# Altium schematic sheet Amps.SchDoc (part 2 of 2)
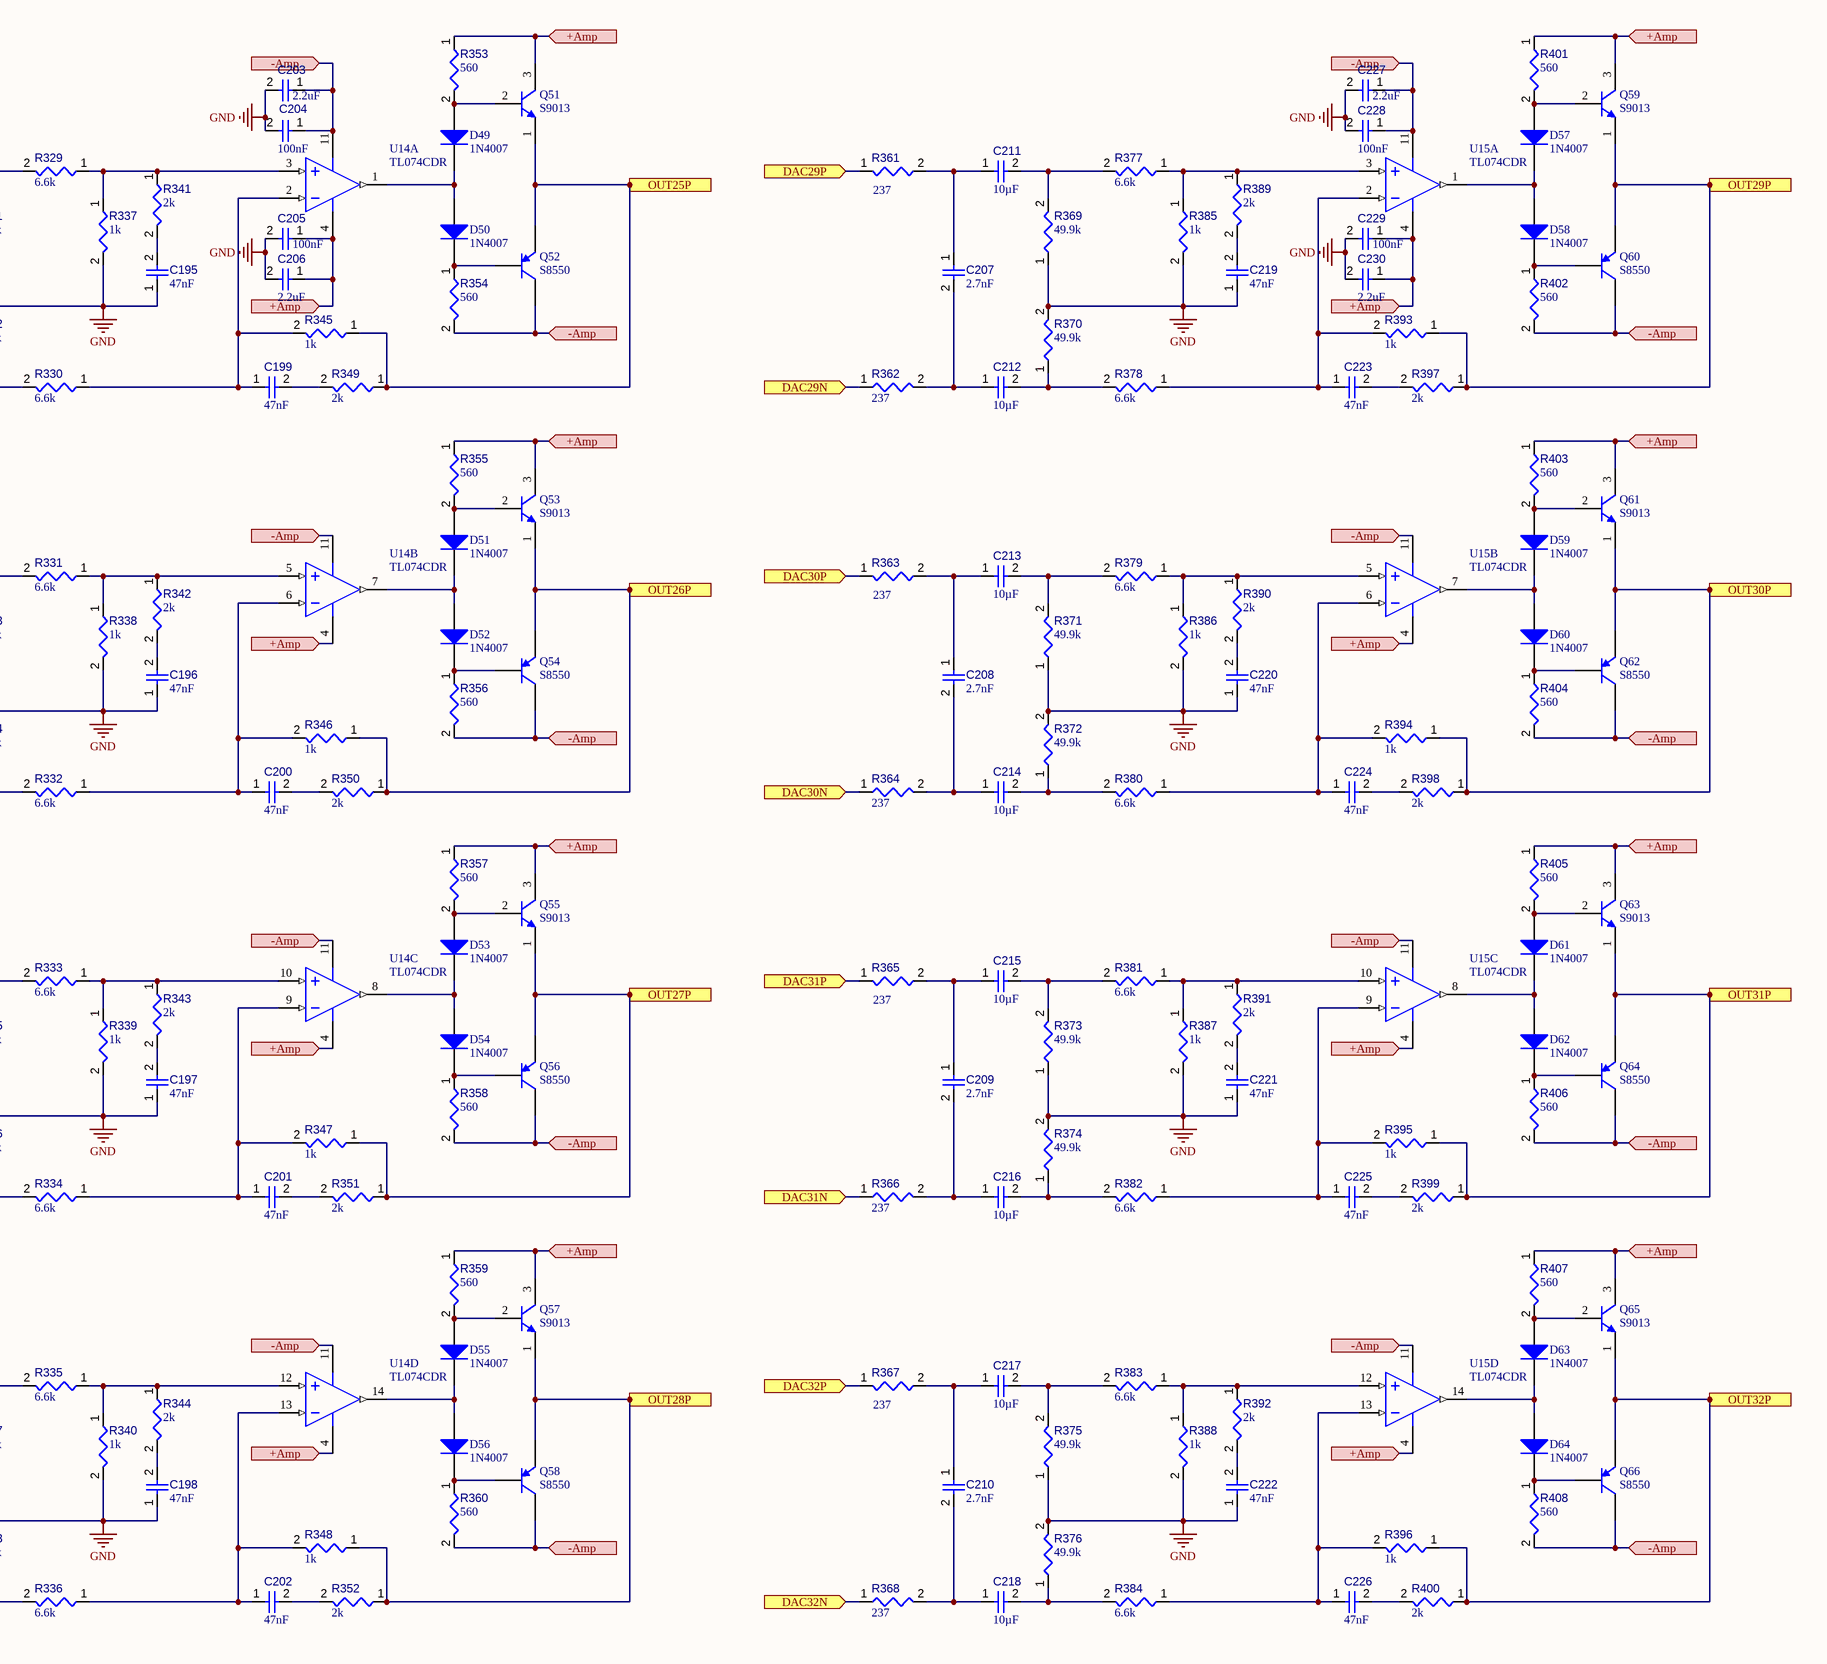
[diagram p5: Amps.SchDoc, column 5 of 5]

## Nets
GND: C51.1 C52.1 C53.1 C54.1 C59.2 C60.2 C61.2 C62.2 C75.1 C76.1 C77.1 C78.1 C83.2 C84.2 C85.2 C86.2 C99.1 C100.1 C101.1 C102.1 C107.2 C108.2 C109.2 C110.2 C123.1 C124.1 C125.1 C126.1 C131.2 C132.2 C133.2 C134.2 C147.1 C148.1 C149.1 C150.1 C155.2 C156.2 C157.2 C158.2 C171.1 C172.1 C173.1 C174.1 C179.2 C180.2 C181.2 C182.2 C195.1 C196.1 C197.1 C198.1 C203.2 C204.2 C205.2 C206.2 C219.1 C220.1 C221.1 C222.1 C227.2 C228.2 C229.2 C230.2 R33.1 R34.2 R35.1 R36.2 R37.1 R38.2 R39.1 R40.2 R49.2 R50.2 R51.2 R52.2 R81.1 R82.2 R83.1 R84.2 R85.1 R86.2 R87.1 R88.2 R97.2 R98.2 R99.2 R100.2 R129.1 R130.2 R131.1 R132.2 R133.1 R134.2 R135.1 R136.2 R145.2 R146.2 R147.2 R148.2 R177.1 R178.2 R179.1 R180.2 R181.1 R182.2 R183.1 R184.2 R193.2 R194.2 R195.2 R196.2 R225.1 R226.2 R227.1 R228.2 R229.1 R230.2 R231.1 R232.2 R241.2 R242.2 R243.2 R244.2 R273.1 R274.2 R275.1 R276.2 R277.1 R278.2 R279.1 R280.2 R289.2 R290.2 R291.2 R292.2 R321.1 R322.2 R323.1 R324.2 R325.1 R326.2 R327.1 R328.2 R337.2 R338.2 R339.2 R340.2 R369.1 R370.2 R371.1 R372.2 R373.1 R374.2 R375.1 R376.2 R385.2 R386.2 R387.2 R388.2
+Amp: C61.1 C62.1 C85.1 C86.1 C109.1 C110.1 C133.1 C134.1 C157.1 C158.1 C181.1 C182.1 C205.1 C206.1 C229.1 C230.1 Q3.3(C) Q5.3(C) Q7.3(C) Q9.3(C) Q11.3(C) Q13.3(C) Q15.3(C) Q17.3(C) Q19.3(C) Q21.3(C) Q23.3(C) Q25.3(C) Q27.3(C) Q29.3(C) Q31.3(C) Q33.3(C) Q35.3(C) Q37.3(C) Q39.3(C) Q41.3(C) Q43.3(C) Q45.3(C) Q47.3(C) Q49.3(C) Q51.3(C) Q53.3(C) Q55.3(C) Q57.3(C) Q59.3(C) Q61.3(C) Q63.3(C) Q65.3(C) R65.1 R67.1 R69.1 R71.1 R113.1 R115.1 R117.1 R119.1 R161.1 R163.1 R165.1 R167.1 R209.1 R211.1 R213.1 R215.1 R257.1 R259.1 R261.1 R263.1 R305.1 R307.1 R309.1 R311.1 R353.1 R355.1 R357.1 R359.1 R401.1 R403.1 R405.1 R407.1 U8.4(VCC+) U9.4(VCC+) U10.4(VCC+) U11.4(VCC+) U12.4(VCC+) U13.4(VCC+) U14.4(VCC+) U15.4(VCC+) ; port +Amp
-Amp: C59.1 C60.1 C83.1 C84.1 C107.1 C108.1 C131.1 C132.1 C155.1 C156.1 C179.1 C180.1 C203.1 C204.1 C227.1 C228.1 Q4.3(C) Q6.3(C) Q8.3(C) Q10.3(C) Q12.3(C) Q14.3(C) Q16.3(C) Q18.3(C) Q20.3(C) Q22.3(C) Q24.3(C) Q26.3(C) Q28.3(C) Q30.3(C) Q32.3(C) Q34.3(C) Q36.3(C) Q38.3(C) Q40.3(C) Q42.3(C) Q44.3(C) Q46.3(C) Q48.3(C) Q50.3(C) Q52.3(C) Q54.3(C) Q56.3(C) Q58.3(C) Q60.3(C) Q62.3(C) Q64.3(C) Q66.3(C) R66.2 R68.2 R70.2 R72.2 R114.2 R116.2 R118.2 R120.2 R162.2 R164.2 R166.2 R168.2 R210.2 R212.2 R214.2 R216.2 R258.2 R260.2 R262.2 R264.2 R306.2 R308.2 R310.2 R312.2 R354.2 R356.2 R358.2 R360.2 R402.2 R404.2 R406.2 R408.2 U8.11(VCC-) U9.11(VCC-) U10.11(VCC-) U11.11(VCC-) U12.11(VCC-) U13.11(VCC-) U14.11(VCC-) U15.11(VCC-) ; port -Amp
DAC1N: R26.1 ; port DAC1N
DAC1P: R25.1 ; port DAC1P
DAC2N: R28.1 ; port DAC2N
DAC2P: R27.1 ; port DAC2P
DAC3N: R30.1 ; port DAC3N
DAC3P: R29.1 ; port DAC3P
DAC4N: R32.1 ; port DAC4N
DAC4P: R31.1 ; port DAC4P
DAC5N: R74.1 ; port DAC5N
DAC5P: R73.1 ; port DAC5P
DAC6N: R76.1 ; port DAC6N
DAC6P: R75.1 ; port DAC6P
DAC7N: R78.1 ; port DAC7N
DAC7P: R77.1 ; port DAC7P
DAC8N: R80.1 ; port DAC8N
DAC8P: R79.1 ; port DAC8P
DAC9N: R122.1 ; port DAC9N
DAC9P: R121.1 ; port DAC9P
DAC10N: R124.1 ; port DAC10N
DAC10P: R123.1 ; port DAC10P
DAC11N: R126.1 ; port DAC11N
DAC11P: R125.1 ; port DAC11P
DAC12N: R128.1 ; port DAC12N
DAC12P: R127.1 ; port DAC12P
DAC13N: R170.1 ; port DAC13N
DAC13P: R169.1 ; port DAC13P
DAC14N: R172.1 ; port DAC14N
DAC14P: R171.1 ; port DAC14P
DAC15N: R174.1 ; port DAC15N
DAC15P: R173.1 ; port DAC15P
DAC16N: R176.1 ; port DAC16N
DAC16P: R175.1 ; port DAC16P
DAC17N: R218.1 ; port DAC17N
DAC17P: R217.1 ; port DAC17P
DAC18N: R220.1 ; port DAC18N
DAC18P: R219.1 ; port DAC18P
DAC19N: R222.1 ; port DAC19N
DAC19P: R221.1 ; port DAC19P
DAC20N: R224.1 ; port DAC20N
DAC20P: R223.1 ; port DAC20P
DAC21N: R266.1 ; port DAC21N
DAC21P: R265.1 ; port DAC21P
DAC22N: R268.1 ; port DAC22N
DAC22P: R267.1 ; port DAC22P
DAC23N: R270.1 ; port DAC23N
DAC23P: R269.1 ; port DAC23P
DAC24N: R272.1 ; port DAC24N
DAC24P: R271.1 ; port DAC24P
DAC25N: R314.1 ; port DAC25N
DAC25P: R313.1 ; port DAC25P
DAC26N: R316.1 ; port DAC26N
DAC26P: R315.1 ; port DAC26P
DAC27N: R318.1 ; port DAC27N
DAC27P: R317.1 ; port DAC27P
DAC28N: R320.1 ; port DAC28N
DAC28P: R319.1 ; port DAC28P
DAC29N: R362.1 ; port DAC29N
DAC29P: R361.1 ; port DAC29P
DAC30N: R364.1 ; port DAC30N
DAC30P: R363.1 ; port DAC30P
DAC31N: R366.1 ; port DAC31N
DAC31P: R365.1 ; port DAC31P
DAC32N: R368.1 ; port DAC32N
DAC32P: R367.1 ; port DAC32P
OUT1P: Q3.1(E) Q4.1(E) R57.1 R61.1 ; port OUT1P
OUT2P: Q5.1(E) Q6.1(E) R58.1 R62.1 ; port OUT2P
OUT3P: Q7.1(E) Q8.1(E) R59.1 R63.1 ; port OUT3P
OUT4P: Q9.1(E) Q10.1(E) R60.1 R64.1 ; port OUT4P
OUT5P: Q11.1(E) Q12.1(E) R105.1 R109.1 ; port OUT5P
OUT6P: Q13.1(E) Q14.1(E) R106.1 R110.1 ; port OUT6P
OUT7P: Q15.1(E) Q16.1(E) R107.1 R111.1 ; port OUT7P
OUT8P: Q17.1(E) Q18.1(E) R108.1 R112.1 ; port OUT8P
OUT9P: Q19.1(E) Q20.1(E) R153.1 R157.1 ; port OUT9P
OUT10P: Q21.1(E) Q22.1(E) R154.1 R158.1 ; port OUT10P
OUT11P: Q23.1(E) Q24.1(E) R155.1 R159.1 ; port OUT11P
OUT12P: Q25.1(E) Q26.1(E) R156.1 R160.1 ; port OUT12P
OUT13P: Q27.1(E) Q28.1(E) R201.1 R205.1 ; port OUT13P
OUT14P: Q29.1(E) Q30.1(E) R202.1 R206.1 ; port OUT14P
OUT15P: Q31.1(E) Q32.1(E) R203.1 R207.1 ; port OUT15P
OUT16P: Q33.1(E) Q34.1(E) R204.1 R208.1 ; port OUT16P
OUT17P: Q35.1(E) Q36.1(E) R249.1 R253.1 ; port OUT17P
OUT18P: Q37.1(E) Q38.1(E) R250.1 R254.1 ; port OUT18P
OUT19P: Q39.1(E) Q40.1(E) R251.1 R255.1 ; port OUT19P
OUT20P: Q41.1(E) Q42.1(E) R252.1 R256.1 ; port OUT20P
OUT21P: Q43.1(E) Q44.1(E) R297.1 R301.1 ; port OUT21P
OUT22P: Q45.1(E) Q46.1(E) R298.1 R302.1 ; port OUT22P
OUT23P: Q47.1(E) Q48.1(E) R299.1 R303.1 ; port OUT23P
OUT24P: Q49.1(E) Q50.1(E) R300.1 R304.1 ; port OUT24P
OUT25P: Q51.1(E) Q52.1(E) R345.1 R349.1 ; port OUT25P
OUT26P: Q53.1(E) Q54.1(E) R346.1 R350.1 ; port OUT26P
OUT27P: Q55.1(E) Q56.1(E) R347.1 R351.1 ; port OUT27P
OUT28P: Q57.1(E) Q58.1(E) R348.1 R352.1 ; port OUT28P
OUT29P: Q59.1(E) Q60.1(E) R393.1 R397.1 ; port OUT29P
OUT30P: Q61.1(E) Q62.1(E) R394.1 R398.1 ; port OUT30P
OUT31P: Q63.1(E) Q64.1(E) R395.1 R399.1 ; port OUT31P
OUT32P: Q65.1(E) Q66.1(E) R396.1 R400.1 ; port OUT32P
NetC39_1: C39.1 C43.1 R25.2
NetC39_2: C39.2 C44.1 R26.2
NetC40_1: C40.1 C45.1 R27.2
NetC40_2: C40.2 C46.1 R28.2
NetC41_1: C41.1 C47.1 R29.2
NetC41_2: C41.2 C48.1 R30.2
NetC42_1: C42.1 C49.1 R31.2
NetC42_2: C42.2 C50.1 R32.2
NetC43_2: C43.2 R33.2 R41.2
NetC44_2: C44.2 R34.1 R42.2
NetC45_2: C45.2 R35.2 R43.2
NetC46_2: C46.2 R36.1 R44.2
NetC47_2: C47.2 R37.2 R45.2
NetC48_2: C48.2 R38.1 R46.2
NetC49_2: C49.2 R39.2 R47.2
NetC50_2: C50.2 R40.1 R48.2
NetC51_2: C51.2 R53.2
NetC52_2: C52.2 R54.2
NetC53_2: C53.2 R55.2
NetC54_2: C54.2 R56.2
NetC55_1: C55.1 R42.1 R57.2 U8.13(IN4-)
NetC55_2: C55.2 R61.2
NetC56_1: C56.1 R44.1 R58.2 U8.9(IN3-)
NetC56_2: C56.2 R62.2
NetC57_1: C57.1 R46.1 R59.2 U8.6(IN2-)
NetC57_2: C57.2 R63.2
NetC58_1: C58.1 R48.1 R60.2 U8.2(IN1-)
NetC58_2: C58.2 R64.2
NetC63_1: C63.1 C67.1 R73.2
NetC63_2: C63.2 C68.1 R74.2
NetC64_1: C64.1 C69.1 R75.2
NetC64_2: C64.2 C70.1 R76.2
NetC65_1: C65.1 C71.1 R77.2
NetC65_2: C65.2 C72.1 R78.2
NetC66_1: C66.1 C73.1 R79.2
NetC66_2: C66.2 C74.1 R80.2
NetC67_2: C67.2 R81.2 R89.2
NetC68_2: C68.2 R82.1 R90.2
NetC69_2: C69.2 R83.2 R91.2
NetC70_2: C70.2 R84.1 R92.2
NetC71_2: C71.2 R85.2 R93.2
NetC72_2: C72.2 R86.1 R94.2
NetC73_2: C73.2 R87.2 R95.2
NetC74_2: C74.2 R88.1 R96.2
NetC75_2: C75.2 R101.2
NetC76_2: C76.2 R102.2
NetC77_2: C77.2 R103.2
NetC78_2: C78.2 R104.2
NetC79_1: C79.1 R90.1 R105.2 U9.13(IN4-)
NetC79_2: C79.2 R109.2
NetC80_1: C80.1 R92.1 R106.2 U9.9(IN3-)
NetC80_2: C80.2 R110.2
NetC81_1: C81.1 R94.1 R107.2 U9.6(IN2-)
NetC81_2: C81.2 R111.2
NetC82_1: C82.1 R96.1 R108.2 U9.2(IN1-)
NetC82_2: C82.2 R112.2
NetC87_1: C87.1 C91.1 R121.2
NetC87_2: C87.2 C92.1 R122.2
NetC88_1: C88.1 C93.1 R123.2
NetC88_2: C88.2 C94.1 R124.2
NetC89_1: C89.1 C95.1 R125.2
NetC89_2: C89.2 C96.1 R126.2
NetC90_1: C90.1 C97.1 R127.2
NetC90_2: C90.2 C98.1 R128.2
NetC91_2: C91.2 R129.2 R137.2
NetC92_2: C92.2 R130.1 R138.2
NetC93_2: C93.2 R131.2 R139.2
NetC94_2: C94.2 R132.1 R140.2
NetC95_2: C95.2 R133.2 R141.2
NetC96_2: C96.2 R134.1 R142.2
NetC97_2: C97.2 R135.2 R143.2
NetC98_2: C98.2 R136.1 R144.2
NetC99_2: C99.2 R149.2
NetC100_2: C100.2 R150.2
NetC101_2: C101.2 R151.2
NetC102_2: C102.2 R152.2
NetC103_1: C103.1 R138.1 R153.2 U10.13(IN4-)
NetC103_2: C103.2 R157.2
NetC104_1: C104.1 R140.1 R154.2 U10.9(IN3-)
NetC104_2: C104.2 R158.2
NetC105_1: C105.1 R142.1 R155.2 U10.6(IN2-)
NetC105_2: C105.2 R159.2
NetC106_1: C106.1 R144.1 R156.2 U10.2(IN1-)
NetC106_2: C106.2 R160.2
NetC111_1: C111.1 C115.1 R169.2
NetC111_2: C111.2 C116.1 R170.2
NetC112_1: C112.1 C117.1 R171.2
NetC112_2: C112.2 C118.1 R172.2
NetC113_1: C113.1 C119.1 R173.2
NetC113_2: C113.2 C120.1 R174.2
NetC114_1: C114.1 C121.1 R175.2
NetC114_2: C114.2 C122.1 R176.2
NetC115_2: C115.2 R177.2 R185.2
NetC116_2: C116.2 R178.1 R186.2
NetC117_2: C117.2 R179.2 R187.2
NetC118_2: C118.2 R180.1 R188.2
NetC119_2: C119.2 R181.2 R189.2
NetC120_2: C120.2 R182.1 R190.2
NetC121_2: C121.2 R183.2 R191.2
NetC122_2: C122.2 R184.1 R192.2
NetC123_2: C123.2 R197.2
NetC124_2: C124.2 R198.2
NetC125_2: C125.2 R199.2
NetC126_2: C126.2 R200.2
NetC127_1: C127.1 R186.1 R201.2 U11.2(IN1-)
NetC127_2: C127.2 R205.2
NetC128_1: C128.1 R188.1 R202.2 U11.6(IN2-)
NetC128_2: C128.2 R206.2
NetC129_1: C129.1 R190.1 R203.2 U11.9(IN3-)
NetC129_2: C129.2 R207.2
NetC130_1: C130.1 R192.1 R204.2 U11.13(IN4-)
NetC130_2: C130.2 R208.2
NetC135_1: C135.1 C139.1 R217.2
NetC135_2: C135.2 C140.1 R218.2
NetC136_1: C136.1 C141.1 R219.2
NetC136_2: C136.2 C142.1 R220.2
NetC137_1: C137.1 C143.1 R221.2
NetC137_2: C137.2 C144.1 R222.2
NetC138_1: C138.1 C145.1 R223.2
NetC138_2: C138.2 C146.1 R224.2
NetC139_2: C139.2 R225.2 R233.2
NetC140_2: C140.2 R226.1 R234.2
NetC141_2: C141.2 R227.2 R235.2
NetC142_2: C142.2 R228.1 R236.2
NetC143_2: C143.2 R229.2 R237.2
NetC144_2: C144.2 R230.1 R238.2
NetC145_2: C145.2 R231.2 R239.2
NetC146_2: C146.2 R232.1 R240.2
NetC147_2: C147.2 R245.2
NetC148_2: C148.2 R246.2
NetC149_2: C149.2 R247.2
NetC150_2: C150.2 R248.2
NetC151_1: C151.1 R234.1 R249.2 U12.2(IN1-)
NetC151_2: C151.2 R253.2
NetC152_1: C152.1 R236.1 R250.2 U12.6(IN2-)
NetC152_2: C152.2 R254.2
NetC153_1: C153.1 R238.1 R251.2 U12.9(IN3-)
NetC153_2: C153.2 R255.2
NetC154_1: C154.1 R240.1 R252.2 U12.13(IN4-)
NetC154_2: C154.2 R256.2
NetC159_1: C159.1 C163.1 R265.2
NetC159_2: C159.2 C164.1 R266.2
NetC160_1: C160.1 C165.1 R267.2
NetC160_2: C160.2 C166.1 R268.2
NetC161_1: C161.1 C167.1 R269.2
NetC161_2: C161.2 C168.1 R270.2
NetC162_1: C162.1 C169.1 R271.2
NetC162_2: C162.2 C170.1 R272.2
NetC163_2: C163.2 R273.2 R281.2
NetC164_2: C164.2 R274.1 R282.2
NetC165_2: C165.2 R275.2 R283.2
NetC166_2: C166.2 R276.1 R284.2
NetC167_2: C167.2 R277.2 R285.2
NetC168_2: C168.2 R278.1 R286.2
NetC169_2: C169.2 R279.2 R287.2
NetC170_2: C170.2 R280.1 R288.2
NetC171_2: C171.2 R293.2
NetC172_2: C172.2 R294.2
NetC173_2: C173.2 R295.2
NetC174_2: C174.2 R296.2
NetC175_1: C175.1 R282.1 R297.2 U13.2(IN1-)
NetC175_2: C175.2 R301.2
NetC176_1: C176.1 R284.1 R298.2 U13.6(IN2-)
NetC176_2: C176.2 R302.2
NetC177_1: C177.1 R286.1 R299.2 U13.9(IN3-)
NetC177_2: C177.2 R303.2
NetC178_1: C178.1 R288.1 R300.2 U13.13(IN4-)
NetC178_2: C178.2 R304.2
NetC183_1: C183.1 C187.1 R313.2
NetC183_2: C183.2 C188.1 R314.2
NetC184_1: C184.1 C189.1 R315.2
NetC184_2: C184.2 C190.1 R316.2
NetC185_1: C185.1 C191.1 R317.2
NetC185_2: C185.2 C192.1 R318.2
NetC186_1: C186.1 C193.1 R319.2
NetC186_2: C186.2 C194.1 R320.2
NetC187_2: C187.2 R321.2 R329.2
NetC188_2: C188.2 R322.1 R330.2
NetC189_2: C189.2 R323.2 R331.2
NetC190_2: C190.2 R324.1 R332.2
NetC191_2: C191.2 R325.2 R333.2
NetC192_2: C192.2 R326.1 R334.2
NetC193_2: C193.2 R327.2 R335.2
NetC194_2: C194.2 R328.1 R336.2
NetC195_2: C195.2 R341.2
NetC196_2: C196.2 R342.2
NetC197_2: C197.2 R343.2
NetC198_2: C198.2 R344.2
NetC199_1: C199.1 R330.1 R345.2 U14.2(IN1-)
NetC199_2: C199.2 R349.2
NetC200_1: C200.1 R332.1 R346.2 U14.6(IN2-)
NetC200_2: C200.2 R350.2
NetC201_1: C201.1 R334.1 R347.2 U14.9(IN3-)
NetC201_2: C201.2 R351.2
NetC202_1: C202.1 R336.1 R348.2 U14.13(IN4-)
NetC202_2: C202.2 R352.2
NetC207_1: C207.1 C211.1 R361.2
NetC207_2: C207.2 C212.1 R362.2
NetC208_1: C208.1 C213.1 R363.2
NetC208_2: C208.2 C214.1 R364.2
NetC209_1: C209.1 C215.1 R365.2
NetC209_2: C209.2 C216.1 R366.2
NetC210_1: C210.1 C217.1 R367.2
NetC210_2: C210.2 C218.1 R368.2
NetC211_2: C211.2 R369.2 R377.2
NetC212_2: C212.2 R370.1 R378.2
NetC213_2: C213.2 R371.2 R379.2
NetC214_2: C214.2 R372.1 R380.2
NetC215_2: C215.2 R373.2 R381.2
NetC216_2: C216.2 R374.1 R382.2
NetC217_2: C217.2 R375.2 R383.2
NetC218_2: C218.2 R376.1 R384.2
NetC219_2: C219.2 R389.2
NetC220_2: C220.2 R390.2
NetC221_2: C221.2 R391.2
NetC222_2: C222.2 R392.2
NetC223_1: C223.1 R378.1 R393.2 U15.2(IN1-)
NetC223_2: C223.2 R397.2
NetC224_1: C224.1 R380.1 R394.2 U15.6(IN2-)
NetC224_2: C224.2 R398.2
NetC225_1: C225.1 R382.1 R395.2 U15.9(IN3-)
NetC225_2: C225.2 R399.2
NetC226_1: C226.1 R384.1 R396.2 U15.13(IN4-)
NetC226_2: C226.2 R400.2
NetD1_1: D1.1(K) D2.2(A) U8.14(OUT4)
NetD1_2: D1.2(A) Q3.2(B) R65.2
NetD2_1: D2.1(K) Q4.2(B) R66.1
NetD3_1: D3.1(K) D4.2(A) U8.8(OUT3)
NetD3_2: D3.2(A) Q5.2(B) R67.2
NetD4_1: D4.1(K) Q6.2(B) R68.1
NetD5_1: D5.1(K) D6.2(A) U8.7(OUT2)
NetD5_2: D5.2(A) Q7.2(B) R69.2
NetD6_1: D6.1(K) Q8.2(B) R70.1
NetD7_1: D7.1(K) D8.2(A) U8.1(OUT1)
NetD7_2: D7.2(A) Q9.2(B) R71.2
NetD8_1: D8.1(K) Q10.2(B) R72.1
NetD9_1: D9.1(K) D10.2(A) U9.14(OUT4)
NetD9_2: D9.2(A) Q11.2(B) R113.2
NetD10_1: D10.1(K) Q12.2(B) R114.1
NetD11_1: D11.1(K) D12.2(A) U9.8(OUT3)
NetD11_2: D11.2(A) Q13.2(B) R115.2
NetD12_1: D12.1(K) Q14.2(B) R116.1
NetD13_1: D13.1(K) D14.2(A) U9.7(OUT2)
NetD13_2: D13.2(A) Q15.2(B) R117.2
NetD14_1: D14.1(K) Q16.2(B) R118.1
NetD15_1: D15.1(K) D16.2(A) U9.1(OUT1)
NetD15_2: D15.2(A) Q17.2(B) R119.2
NetD16_1: D16.1(K) Q18.2(B) R120.1
NetD17_1: D17.1(K) D18.2(A) U10.14(OUT4)
NetD17_2: D17.2(A) Q19.2(B) R161.2
NetD18_1: D18.1(K) Q20.2(B) R162.1
NetD19_1: D19.1(K) D20.2(A) U10.8(OUT3)
NetD19_2: D19.2(A) Q21.2(B) R163.2
NetD20_1: D20.1(K) Q22.2(B) R164.1
NetD21_1: D21.1(K) D22.2(A) U10.7(OUT2)
NetD21_2: D21.2(A) Q23.2(B) R165.2
NetD22_1: D22.1(K) Q24.2(B) R166.1
NetD23_1: D23.1(K) D24.2(A) U10.1(OUT1)
NetD23_2: D23.2(A) Q25.2(B) R167.2
NetD24_1: D24.1(K) Q26.2(B) R168.1
NetD25_1: D25.1(K) D26.2(A) U11.1(OUT1)
NetD25_2: D25.2(A) Q27.2(B) R209.2
NetD26_1: D26.1(K) Q28.2(B) R210.1
NetD27_1: D27.1(K) D28.2(A) U11.7(OUT2)
NetD27_2: D27.2(A) Q29.2(B) R211.2
NetD28_1: D28.1(K) Q30.2(B) R212.1
NetD29_1: D29.1(K) D30.2(A) U11.8(OUT3)
NetD29_2: D29.2(A) Q31.2(B) R213.2
NetD30_1: D30.1(K) Q32.2(B) R214.1
NetD31_1: D31.1(K) D32.2(A) U11.14(OUT4)
NetD31_2: D31.2(A) Q33.2(B) R215.2
NetD32_1: D32.1(K) Q34.2(B) R216.1
NetD33_1: D33.1(K) D34.2(A) U12.1(OUT1)
NetD33_2: D33.2(A) Q35.2(B) R257.2
NetD34_1: D34.1(K) Q36.2(B) R258.1
NetD35_1: D35.1(K) D36.2(A) U12.7(OUT2)
NetD35_2: D35.2(A) Q37.2(B) R259.2
NetD36_1: D36.1(K) Q38.2(B) R260.1
NetD37_1: D37.1(K) D38.2(A) U12.8(OUT3)
NetD37_2: D37.2(A) Q39.2(B) R261.2
NetD38_1: D38.1(K) Q40.2(B) R262.1
NetD39_1: D39.1(K) D40.2(A) U12.14(OUT4)
NetD39_2: D39.2(A) Q41.2(B) R263.2
NetD40_1: D40.1(K) Q42.2(B) R264.1
NetD41_1: D41.1(K) D42.2(A) U13.1(OUT1)
NetD41_2: D41.2(A) Q43.2(B) R305.2
NetD42_1: D42.1(K) Q44.2(B) R306.1
NetD43_1: D43.1(K) D44.2(A) U13.7(OUT2)
NetD43_2: D43.2(A) Q45.2(B) R307.2
NetD44_1: D44.1(K) Q46.2(B) R308.1
NetD45_1: D45.1(K) D46.2(A) U13.8(OUT3)
NetD45_2: D45.2(A) Q47.2(B) R309.2
NetD46_1: D46.1(K) Q48.2(B) R310.1
NetD47_1: D47.1(K) D48.2(A) U13.14(OUT4)
NetD47_2: D47.2(A) Q49.2(B) R311.2
NetD48_1: D48.1(K) Q50.2(B) R312.1
NetD49_1: D49.1(K) D50.2(A) U14.1(OUT1)
NetD49_2: D49.2(A) Q51.2(B) R353.2
NetD50_1: D50.1(K) Q52.2(B) R354.1
NetD51_1: D51.1(K) D52.2(A) U14.7(OUT2)
NetD51_2: D51.2(A) Q53.2(B) R355.2
NetD52_1: D52.1(K) Q54.2(B) R356.1
NetD53_1: D53.1(K) D54.2(A) U14.8(OUT3)
NetD53_2: D53.2(A) Q55.2(B) R357.2
NetD54_1: D54.1(K) Q56.2(B) R358.1
NetD55_1: D55.1(K) D56.2(A) U14.14(OUT4)
NetD55_2: D55.2(A) Q57.2(B) R359.2
NetD56_1: D56.1(K) Q58.2(B) R360.1
NetD57_1: D57.1(K) D58.2(A) U15.1(OUT1)
NetD57_2: D57.2(A) Q59.2(B) R401.2
NetD58_1: D58.1(K) Q60.2(B) R402.1
NetD59_1: D59.1(K) D60.2(A) U15.7(OUT2)
NetD59_2: D59.2(A) Q61.2(B) R403.2
NetD60_1: D60.1(K) Q62.2(B) R404.1
NetD61_1: D61.1(K) D62.2(A) U15.8(OUT3)
NetD61_2: D61.2(A) Q63.2(B) R405.2
NetD62_1: D62.1(K) Q64.2(B) R406.1
NetD63_1: D63.1(K) D64.2(A) U15.14(OUT4)
NetD63_2: D63.2(A) Q65.2(B) R407.2
NetD64_1: D64.1(K) Q66.2(B) R408.1
NetR41_1: R41.1 R49.1 R53.1 U8.12(IN4+)
NetR43_1: R43.1 R50.1 R54.1 U8.10(IN3+)
NetR45_1: R45.1 R51.1 R55.1 U8.5(IN2+)
NetR47_1: R47.1 R52.1 R56.1 U8.3(IN1+)
NetR89_1: R89.1 R97.1 R101.1 U9.12(IN4+)
NetR91_1: R91.1 R98.1 R102.1 U9.10(IN3+)
NetR93_1: R93.1 R99.1 R103.1 U9.5(IN2+)
NetR95_1: R95.1 R100.1 R104.1 U9.3(IN1+)
NetR137_1: R137.1 R145.1 R149.1 U10.12(IN4+)
NetR139_1: R139.1 R146.1 R150.1 U10.10(IN3+)
NetR141_1: R141.1 R147.1 R151.1 U10.5(IN2+)
NetR143_1: R143.1 R148.1 R152.1 U10.3(IN1+)
NetR185_1: R185.1 R193.1 R197.1 U11.3(IN1+)
NetR187_1: R187.1 R194.1 R198.1 U11.5(IN2+)
NetR189_1: R189.1 R195.1 R199.1 U11.10(IN3+)
NetR191_1: R191.1 R196.1 R200.1 U11.12(IN4+)
NetR233_1: R233.1 R241.1 R245.1 U12.3(IN1+)
NetR235_1: R235.1 R242.1 R246.1 U12.5(IN2+)
NetR237_1: R237.1 R243.1 R247.1 U12.10(IN3+)
NetR239_1: R239.1 R244.1 R248.1 U12.12(IN4+)
NetR281_1: R281.1 R289.1 R293.1 U13.3(IN1+)
NetR283_1: R283.1 R290.1 R294.1 U13.5(IN2+)
NetR285_1: R285.1 R291.1 R295.1 U13.10(IN3+)
NetR287_1: R287.1 R292.1 R296.1 U13.12(IN4+)
NetR329_1: R329.1 R337.1 R341.1 U14.3(IN1+)
NetR331_1: R331.1 R338.1 R342.1 U14.5(IN2+)
NetR333_1: R333.1 R339.1 R343.1 U14.10(IN3+)
NetR335_1: R335.1 R340.1 R344.1 U14.12(IN4+)
NetR377_1: R377.1 R385.1 R389.1 U15.3(IN1+)
NetR379_1: R379.1 R386.1 R390.1 U15.5(IN2+)
NetR381_1: R381.1 R387.1 R391.1 U15.10(IN3+)
NetR383_1: R383.1 R388.1 R392.1 U15.12(IN4+)

## Library data of the parts
C39-C42 C51-C66 C75-C90 C99-C114 C123-C138 C147-C162 C171-C186 C195-C210 C219-C230 = CMP-001-00078-4: Tolerance: 10%; Voltage Rating: 50V; Case/Package: 0603; Pins: 2; Max Operating Temperature: 85°C; Mounting Technology: SMT; Min Operating Temperature: -55°C
C43-C50 C67-C74 C91-C98 C115-C122 C139-C146 C163-C170 C187-C194 C211-C218 = CMP-001-00079-4: Chip Capacitor, 10µF +/-20%, 25V, 0805, Thickness 1.45 mm; Tolerance: 10%; Min Operating Temperature: -55°C; Voltage Rating: 25V; Case/Package: 0805; Max Operating Temperature: 85°C; Mounting Technology: SMT; Pins: 2
D1-D64 = CMP-004-00007-2: General Purpose Rectifier, 1.1 V, 1.0 A, -55 to 175 degC, 2-Pin DO-41, RoHS, Tape and Reel; Manufacturer: Fairchild; Peak Reverse Current: 5uA; Max Surge Current: 30A; Elements: 1; Forward Voltage: 1.1V; Package Version: Rev. 2, 09/2008; Forward Current: 1A; Package Quantity: 5000; Packaging: TapeandReel; Package URL: http://www.fairchildsemi.com/dwg/DO/DO41A.pdf; Manufacturer URL: https://www.fairchildsemi.com/; Package Reference: DO-41-2; Pins: 2; Min Operating Temperature: -55°C; Datasheet Version: Rev. 1.1.0, 11/2014; Max Operating Temperature: 175°C; RoHS Compliant: True; Case/Package: DO-41-2; Mounting Technology: TH; Package Description: 2-Pin Axial Lead, Dia 2.375 mm, Body Length 4.63 mm; Datasheet URL: https://www.fairchildsemi.com/datasheets/1N/1N4007.pdf
Q3 Q5 Q7 Q9 Q11 Q13 Q15 Q17 Q19 Q21 Q23 Q25 Q27 Q29 Q31 Q33 Q35 Q37 Q39 Q41 Q43 Q45 Q47 Q49 Q51 Q53 Q55 Q57 Q59 Q61 Q63 Q65 = CMP-013-00000-3: Transistor, NPN, 0.1 uA, 150 MHz, 3-Pin TO-92; Manufacturer: Jiangsu Changjiang Electronics Technology; Case/Package: TO-92-3; Datasheet URL: http://www.cj-elec.com/txUpfile/20121910315050632.pdf; Datasheet Version: Rev. B, 11/2011; Package Description: 3-Pin Through Hole Device, Height 4.7 mm, Pitch 2.3 mm; Mounting Technology: TH; RoHS Compliant: False; Package Reference: TO-92-3
Q4 Q6 Q8 Q10 Q12 Q14 Q16 Q18 Q20 Q22 Q24 Q26 Q28 Q30 Q32 Q34 Q36 Q38 Q40 Q42 Q44 Q46 Q48 Q50 Q52 Q54 Q56 Q58 Q60 Q62 Q64 Q66 = CMP-013-00004-3: Low Voltage High Current Small Signal PNP Transistor, 20 V, 700 mA, 3-Pin TO-92, RoHS; Manufacturer: Unisonic; Mounting Technology: TH; Package Description: 3-Pin Through Hole Device, Dia 4.58 mm, Pitch 1.27 mm; Datasheet URL: http://media.nkcelectronics.com/datasheet/s8550.pdf; Case/Package: TO-92-3; Datasheet Version: Rev. E, 06/2014; Package Reference: TO-92-3; RoHS Compliant: Unknown
R25-R32 R73-R80 R121-R128 R169-R176 R217-R224 R265-R272 R313-R320 R361-R368 = CMP-009-00175-3: 237 ohm 0603; Pins: 2; Min Operating Temperature: -55°C; Max Operating Temperature: 155°C; Case/Package: 0603; Value: 237
R33 R35 R37 R39 R41-R72 R81 R83 R85 R87 R89-R120 R129 R131 R133 R135 R137-R168 R177 R179 R181 R183 R185-R216 R225 R227 R229 R231 R233-R264 R273 R275 R277 R279 R281-R312 R321 R323 R325 R327 R329-R360 R369 R371 R373 R375 R377-R408 = CMP-009-00175-3: Pins: 2; Min Operating Temperature: -55°C; Max Operating Temperature: 155°C; Case/Package: 0603
R34 R36 R38 R40 R82 R84 R86 R88 R130 R132 R134 R136 R178 R180 R182 R184 R226 R228 R230 R232 R274 R276 R278 R280 R322 R324 R326 R328 R370 R372 R374 R376 = CMP-009-00175-3: 1.5k 0603; Pins: 2; Min Operating Temperature: -55°C; Max Operating Temperature: 155°C; Case/Package: 0603
U8-U15 = CMP-0017-00003-2: Quad Low-Noise JFET-Input General-Purpose Operational Amplifier, 7 to 36 V, 0 to 70 degC, 14-pin SOIC (D14), Green (RoHS & no Sb/Br); Manufacturer: Texas Instruments; Slew Rate(Typ)(V/us): 13; IIB(Max)(pA): 200; Number of Channels: 4; CMRR(Min)(dB): 70; Vn at 1kHz(Typ)(nV/rtHz): 18; Vio (25C)(Max)(mV): 10; Sub Family: General Purpose Amplifier, High Supply Voltage Amplifier (>=30V); Total Supply Voltage(Max)(+5V is 5, +/-5V is 10): 36; Total Supply Voltage(Min)(+5V is 5, +/-5V is 10): 7; GBW(Typ)(MHz): 3; Rating: Military; Iq per channel(Max)(mA): 2.5; Eco-Plan: Green (RoHS & no Sb/Br); ComponentLink3Description: Package Specification; ComponentLink1URL: http://www.ti.com/; Mounting Technology: Surface Mount; ComponentLink3URL: http://www.ti.com/lit/ml/mpds177g/mpds177g.pdf; PartNumber: TL074CDR; DatasheetVersion: SLOS080J; ComponentLink2URL: http://www.ti.com/lit/ds/symlink/tl074.pdf; ComponentLink1Description: Manufacturer URL; PackageVersion: 4040047-5/M, 06/2011; PackageReference: D0014A; Code_JEDEC: MS-012; ComponentLink2Description: Datasheet; Offset Drift(Typ)(uV/C): 18; PackageDescription: 14-Pin Plastic Small Outline, Body 8.65 x 3.90 mm, Pitch 1.27 mm